# Altium schematic sheet mainboard.schdoc (part 2 of 2) (continued)
## Nets (continued)
INTR: D21.18(INTR) D40.17(INT)
IOCOM/: D4.13 D34.6 D42.9 D42.12
IOR/: D53.18(X1) X7.45(B14) X8.45(B14) X9.45(B14) X10.45(B14) X11.45(B14) X12.45(B14) X13.45(B14) X14.45(B14)
IORD/: D2.2 D30.13(IOR) D31.1 D34.13 D47.1(~{I/OR}) D51.15(B3) D53.2(A1) DR3.3
IOW/: D53.16(X2) X7.44(B13) X8.44(B13) X9.44(B13) X10.44(B13) X11.44(B13) X12.44(B13) X13.44(B13) X14.44(B13)
IOWR/: D2.4 D30.12(AIOW) D47.2(~{I/OW}) D51.17(B4) D53.4(A2) D61.10 D61.12 DR3.2
IREN/: D24.13(OE) D45.21(PB3)
IRQ: D50.11 D54.19(~{IRQ}) R34.1
IRQ0: D40.18(IR0) D49.10(OUT0)
IRQ1: D5.9(Q2) D37.12 D37.13 D40.19(IR1)
IRQ2: D40.20(IR2) S6.4 X7.35(B4) X8.35(B4) X9.35(B4) X10.35(B4) X11.35(B4) X12.35(B4) X13.35(B4) X14.35(B4)
IRQ3: D40.21(IR3) S6.6 X7.56(B25) X8.56(B25) X9.56(B25) X10.56(B25) X11.56(B25) X12.56(B25) X13.56(B25) X14.56(B25)
IRQ4: D40.22(IR4) S6.8 X7.55(B24) X8.55(B24) X9.55(B24) X10.55(B24) X11.55(B24) X12.55(B24) X13.55(B24) X14.55(B24)
IRQ5: D40.23(IR5) X7.54(B23) X8.54(B23) X9.54(B23) X10.54(B23) X11.54(B23) X12.54(B23) X13.54(B23) X14.54(B23)
IRQ6: D40.24(IR6) X7.53(B22) X8.53(B22) X9.53(B22) X10.53(B22) X11.53(B22) X12.53(B22) X13.53(B22) X14.53(B22)
IRQ7: D40.25(IR7) S6.2 X7.52(B21) X8.52(B21) X9.52(B21) X10.52(B21) X11.52(B21) X12.52(B21) X13.52(B21) X14.52(B21)
KBCLK: D36.2(D1) D37.8 R15.2 X3.1
KBDATA: D37.11 D38.11(SR) R12.2 X4.2
LAEN: D16.4 D16.5 D24.4(OE)
LAEN/: D16.6 D24.10(OE) D27.1(OC) D28.1(OC) D29.1(OC) D30.6(AEN) D42.10 D51.1(EX)
LALE: D19.5(Q1) D27.11(G) D28.11(G) D29.11(G)
LDAT0: D40.11(D0) D43.2(A1) D45.34(D0) D47.30(D0) D48.15(D1) D49.8(D0) D52.3(D0) D54.4(AD0) D68.15(D1) D77.18(B1)
LDAT1: D40.10(D1) D43.3(A2) D45.33(D1) D47.29(D1) D48.1(D2) D49.7(D1) D52.4(D1) D54.5(AD1) D68.1(D2) D77.17(B2)
LDAT2: D40.9(D2) D43.4(A3) D45.32(D2) D47.28(D2) D48.2(D3) D49.6(D2) D52.7(D2) D54.6(AD2) D68.2(D3) D77.16(B3)
LDAT3: D40.8(D3) D43.5(A4) D45.31(D3) D47.27(D3) D48.3(D4) D49.5(D3) D52.8(D3) D54.7(AD3) D68.3(D4) D77.15(B4)
LDAT4: D40.7(D4) D43.6(A5) D45.30(D4) D47.26(D4) D49.4(D4) D52.13(D4) D54.8(AD4) D69.15(D1) D77.14(B5)
LDAT5: D40.6(D5) D43.7(A6) D45.29(D5) D47.23(D5) D49.3(D5) D52.14(D5) D54.9(AD5) D69.1(D2) D77.13(B6)
LDAT6: D40.5(D6) D43.8(A7) D45.28(D6) D47.22(D6) D49.2(D6) D52.17(D6) D54.10(AD6) D69.2(D3) D77.12(B7)
LDAT7: D10.12(D2) D40.4(D7) D43.9(A8) D45.27(D7) D47.21(D7) D49.1(D7) D52.18(D7) D54.11(AD7) D69.3(D4) D77.11(B8)
LIOR/: D34.5 D40.3(~{RD}) D45.5(~{RD}) D49.22(~{RD}) D51.5(Y3)
LIOS/: D17.6 D43.19(G)
LIOW/: D4.1 D34.4 D40.2(~{WR}) D42.2 D45.36(~{WR}) D49.23(~{WR}) D51.3(Y4) D54.15(R/~{W})
LOCK/: D2.9 D21.29(LOCK)
LRAM/: D55.10(O3) D62.12 D63.1 R30.2
MAPS/: D4.12 D44.17(15) D61.13 D63.12
MAPW/: D61.11 D70.10(~{WE}) D71.10(~{WE})
MBDHS/: D58.19(G) D61.3
MBDLS/: D56.19(G) D64.3
MEM0: D56.2(A1) D59.11(O0) DS1.2(DI) DS1.14(DO) DS17.2(DI) DS17.14(DO) DS33.2(DI) DS33.14(DO) DS49.2(DI) DS49.14(DO)
MEM1: D56.3(A2) D59.12(O1) DS2.2(DI) DS2.14(DO) DS18.2(DI) DS18.14(DO) DS34.2(DI) DS34.14(DO) DS50.2(DI) DS50.14(DO)
MEM2: D56.4(A3) D59.13(O2) DS3.2(DI) DS3.14(DO) DS19.2(DI) DS19.14(DO) DS35.2(DI) DS35.14(DO) DS51.2(DI) DS51.14(DO)
MEM3: D56.5(A4) D59.15(O3) DS4.2(DI) DS4.14(DO) DS20.2(DI) DS20.14(DO) DS36.2(DI) DS36.14(DO) DS52.2(DI) DS52.14(DO)
MEM4: D56.6(A5) D59.16(O4) DS5.2(DI) DS5.14(DO) DS21.2(DI) DS21.14(DO) DS37.2(DI) DS37.14(DO) DS53.2(DI) DS53.14(DO)
MEM5: D56.7(A6) D59.17(O5) DS6.2(DI) DS6.14(DO) DS22.2(DI) DS22.14(DO) DS38.2(DI) DS38.14(DO) DS54.2(DI) DS54.14(DO)
MEM6: D56.8(A7) D59.18(O6) DS7.2(DI) DS7.14(DO) DS23.2(DI) DS23.14(DO) DS39.2(DI) DS39.14(DO) DS55.2(DI) DS55.14(DO)
MEM7: D56.9(A8) D59.19(O7) DS8.2(DI) DS8.14(DO) DS24.2(DI) DS24.14(DO) DS40.2(DI) DS40.14(DO) DS56.2(DI) DS56.14(DO)
MEM8: D58.2(A1) D60.11(O0) DS9.2(DI) DS9.14(DO) DS25.2(DI) DS25.14(DO) DS41.2(DI) DS41.14(DO) DS57.2(DI) DS57.14(DO)
MEM9: D58.3(A2) D60.12(O1) DS10.2(DI) DS10.14(DO) DS26.2(DI) DS26.14(DO) DS42.2(DI) DS42.14(DO) DS58.2(DI) DS58.14(DO)
MEM10: D58.4(A3) D60.13(O2) DS11.2(DI) DS11.14(DO) DS27.2(DI) DS27.14(DO) DS43.2(DI) DS43.14(DO) DS59.2(DI) DS59.14(DO)
MEM11: D58.5(A4) D60.15(O3) DS12.2(DI) DS12.14(DO) DS28.2(DI) DS28.14(DO) DS44.2(DI) DS44.14(DO) DS60.2(DI) DS60.14(DO)
MEM12: D58.6(A5) D60.16(O4) DS13.2(DI) DS13.14(DO) DS29.2(DI) DS29.14(DO) DS45.2(DI) DS45.14(DO) DS61.2(DI) DS61.14(DO)
MEM13: D58.7(A6) D60.17(O5) DS14.2(DI) DS14.14(DO) DS30.2(DI) DS30.14(DO) DS46.2(DI) DS46.14(DO) DS62.2(DI) DS62.14(DO)
MEM14: D58.8(A7) D60.18(O6) DS15.2(DI) DS15.14(DO) DS31.2(DI) DS31.14(DO) DS47.2(DI) DS47.14(DO) DS63.2(DI) DS63.14(DO)
MEM15: D58.9(A8) D60.19(O7) DS16.2(DI) DS16.14(DO) DS32.2(DI) DS32.14(DO) DS48.2(DI) DS48.14(DO) DS64.2(DI) DS64.14(DO)
MEM16/: D32.2(A5) D55.12(O1) D61.4 R29.1
MEMC/: D61.5 D63.6 D64.5 D65.3 D65.11 D65.12
MEMD/: D2.5 D62.11
MEMR/: D53.14(X3) X7.43(B12) X8.43(B12) X9.43(B12) X10.43(B12) X11.43(B12) X12.43(B12) X13.43(B12) X14.43(B12)
MEMW/: D53.12(X4) X7.42(B11) X8.42(B11) X9.42(B11) X10.42(B11) X11.42(B11) X12.42(B11) X13.42(B11) X14.42(B11)
MPS/: D4.11 D77.19(G)
MRD/: D30.7(MRD) D31.13 D34.12 D47.3(MEMR) D53.6(A3) D63.4 D64.12 DR3.5
MRDP/: D59.22(~{OE}) D60.22(~{OE}) D64.11
MWR/: D30.8(AMW) D47.4(MEMW) D53.8(A4) D63.5 D64.10 DR3.6
MXA: D66.5(Q2) D66.6(D3) D73.1(~{A}/B) D74.1(~{A}/B) D75.14(A)
NMIS/: D4.2 D44.11(10)
OSC: D31.8 D39.1(B) X7.61(B30) X8.61(B30) X9.61(B30) X10.61(B30) X11.61(B30) X12.61(B30) X13.61(B30) X14.61(B30)
OSC24: D6.3(C1) D6.11(C2) D19.3(C1) D66.9(CLK) S1.2
OUT2: D37.4 D45.12(PC5) D49.17(OUT2)
PA0: D38.16(H/QH) D45.4(PA0)
PA1: D38.4(G/QG) D45.3(PA1)
PA2: D38.15(F/QF) D45.2(PA2)
PA3: D38.5(E/QE) D45.1(PA3)
PA4: D38.14(D/QD) D45.40(PA4)
PA5: D38.6(C/QC) D45.39(PA5)
PA6: D38.13(B/QB) D45.38(PA6)
PA7: D38.7(A/QA) D45.37(PA7)
PADR0: D15.12 D45.9(A0) D49.19(A0) D50.3 D51.9(Y1)
PADR1: D45.8(A1) D49.20(A1) D51.7(Y2)
PCLK: D13.2(PCLK) D47.12(CLK)
PGOOD: C133.1 D3.12 D50.5 R35.1 X5.1
PICS/: D40.1(~{CS}) D44.3(2)
PITS/: D44.5(4) D49.21(~{CS})
PPIS/: D44.7(6) D45.6(~{CS})
PROM/: D55.11(O2) D64.13 R31.1
PULUP: D19.1(~{R1}) D19.4(~{S1}) D19.13(~{R2}) DR1.2
QS0: D21.25(QS0) D22.25(QS0)
QS1: D21.24(QS1) D22.24(QS1)
RA0: DR5.2 DS1.5(A0) DS2.5(A0) DS3.5(A0) DS4.5(A0) DS5.5(A0) DS6.5(A0) DS7.5(A0) DS8.5(A0) DS9.5(A0) DS10.5(A0) DS11.5(A0) DS12.5(A0) DS13.5(A0) DS14.5(A0) DS15.5(A0) DS16.5(A0) DS17.5(A0) DS18.5(A0) DS19.5(A0) DS20.5(A0) DS21.5(A0) DS22.5(A0) DS23.5(A0) DS24.5(A0) DS25.5(A0) DS26.5(A0) DS27.5(A0) DS28.5(A0) DS29.5(A0) DS30.5(A0) DS31.5(A0) DS32.5(A0) DS33.5(A0) DS34.5(A0) DS35.5(A0) DS36.5(A0) DS37.5(A0) DS38.5(A0) DS39.5(A0) DS40.5(A0) DS41.5(A0) DS42.5(A0) DS43.5(A0) DS44.5(A0) DS45.5(A0) DS46.5(A0) DS47.5(A0) DS48.5(A0) DS49.5(A0) DS50.5(A0) DS51.5(A0) DS52.5(A0) DS53.5(A0) DS54.5(A0) DS55.5(A0) DS56.5(A0) DS57.5(A0) DS58.5(A0) DS59.5(A0) DS60.5(A0) DS61.5(A0) DS62.5(A0) DS63.5(A0) DS64.5(A0)
RA1: DR5.6 DS1.7(A1) DS2.7(A1) DS3.7(A1) DS4.7(A1) DS5.7(A1) DS6.7(A1) DS7.7(A1) DS8.7(A1) DS9.7(A1) DS10.7(A1) DS11.7(A1) DS12.7(A1) DS13.7(A1) DS14.7(A1) DS15.7(A1) DS16.7(A1) DS17.7(A1) DS18.7(A1) DS19.7(A1) DS20.7(A1) DS21.7(A1) DS22.7(A1) DS23.7(A1) DS24.7(A1) DS25.7(A1) DS26.7(A1) DS27.7(A1) DS28.7(A1) DS29.7(A1) DS30.7(A1) DS31.7(A1) DS32.7(A1) DS33.7(A1) DS34.7(A1) DS35.7(A1) DS36.7(A1) DS37.7(A1) DS38.7(A1) DS39.7(A1) DS40.7(A1) DS41.7(A1) DS42.7(A1) DS43.7(A1) DS44.7(A1) DS45.7(A1) DS46.7(A1) DS47.7(A1) DS48.7(A1) DS49.7(A1) DS50.7(A1) DS51.7(A1) DS52.7(A1) DS53.7(A1) DS54.7(A1) DS55.7(A1) DS56.7(A1) DS57.7(A1) DS58.7(A1) DS59.7(A1) DS60.7(A1) DS61.7(A1) DS62.7(A1) DS63.7(A1) DS64.7(A1)
RA2: DR5.4 DS1.6(A2) DS2.6(A2) DS3.6(A2) DS4.6(A2) DS5.6(A2) DS6.6(A2) DS7.6(A2) DS8.6(A2) DS9.6(A2) DS10.6(A2) DS11.6(A2) DS12.6(A2) DS13.6(A2) DS14.6(A2) DS15.6(A2) DS16.6(A2) DS17.6(A2) DS18.6(A2) DS19.6(A2) DS20.6(A2) DS21.6(A2) DS22.6(A2) DS23.6(A2) DS24.6(A2) DS25.6(A2) DS26.6(A2) DS27.6(A2) DS28.6(A2) DS29.6(A2) DS30.6(A2) DS31.6(A2) DS32.6(A2) DS33.6(A2) DS34.6(A2) DS35.6(A2) DS36.6(A2) DS37.6(A2) DS38.6(A2) DS39.6(A2) DS40.6(A2) DS41.6(A2) DS42.6(A2) DS43.6(A2) DS44.6(A2) DS45.6(A2) DS46.6(A2) DS47.6(A2) DS48.6(A2) DS49.6(A2) DS50.6(A2) DS51.6(A2) DS52.6(A2) DS53.6(A2) DS54.6(A2) DS55.6(A2) DS56.6(A2) DS57.6(A2) DS58.6(A2) DS59.6(A2) DS60.6(A2) DS61.6(A2) DS62.6(A2) DS63.6(A2) DS64.6(A2)
RA3: DR5.3 DS1.12(A3) DS2.12(A3) DS3.12(A3) DS4.12(A3) DS5.12(A3) DS6.12(A3) DS7.12(A3) DS8.12(A3) DS9.12(A3) DS10.12(A3) DS11.12(A3) DS12.12(A3) DS13.12(A3) DS14.12(A3) DS15.12(A3) DS16.12(A3) DS17.12(A3) DS18.12(A3) DS19.12(A3) DS20.12(A3) DS21.12(A3) DS22.12(A3) DS23.12(A3) DS24.12(A3) DS25.12(A3) DS26.12(A3) DS27.12(A3) DS28.12(A3) DS29.12(A3) DS30.12(A3) DS31.12(A3) DS32.12(A3) DS33.12(A3) DS34.12(A3) DS35.12(A3) DS36.12(A3) DS37.12(A3) DS38.12(A3) DS39.12(A3) DS40.12(A3) DS41.12(A3) DS42.12(A3) DS43.12(A3) DS44.12(A3) DS45.12(A3) DS46.12(A3) DS47.12(A3) DS48.12(A3) DS49.12(A3) DS50.12(A3) DS51.12(A3) DS52.12(A3) DS53.12(A3) DS54.12(A3) DS55.12(A3) DS56.12(A3) DS57.12(A3) DS58.12(A3) DS59.12(A3) DS60.12(A3) DS61.12(A3) DS62.12(A3) DS63.12(A3) DS64.12(A3)
RA4: DR5.5 DS1.11(A4) DS2.11(A4) DS3.11(A4) DS4.11(A4) DS5.11(A4) DS6.11(A4) DS7.11(A4) DS8.11(A4) DS9.11(A4) DS10.11(A4) DS11.11(A4) DS12.11(A4) DS13.11(A4) DS14.11(A4) DS15.11(A4) DS16.11(A4) DS17.11(A4) DS18.11(A4) DS19.11(A4) DS20.11(A4) DS21.11(A4) DS22.11(A4) DS23.11(A4) DS24.11(A4) DS25.11(A4) DS26.11(A4) DS27.11(A4) DS28.11(A4) DS29.11(A4) DS30.11(A4) DS31.11(A4) DS32.11(A4) DS33.11(A4) DS34.11(A4) DS35.11(A4) DS36.11(A4) DS37.11(A4) DS38.11(A4) DS39.11(A4) DS40.11(A4) DS41.11(A4) DS42.11(A4) DS43.11(A4) DS44.11(A4) DS45.11(A4) DS46.11(A4) DS47.11(A4) DS48.11(A4) DS49.11(A4) DS50.11(A4) DS51.11(A4) DS52.11(A4) DS53.11(A4) DS54.11(A4) DS55.11(A4) DS56.11(A4) DS57.11(A4) DS58.11(A4) DS59.11(A4) DS60.11(A4) DS61.11(A4) DS62.11(A4) DS63.11(A4) DS64.11(A4)
RA5: DR5.7 DS1.10(A5) DS2.10(A5) DS3.10(A5) DS4.10(A5) DS5.10(A5) DS6.10(A5) DS7.10(A5) DS8.10(A5) DS9.10(A5) DS10.10(A5) DS11.10(A5) DS12.10(A5) DS13.10(A5) DS14.10(A5) DS15.10(A5) DS16.10(A5) DS17.10(A5) DS18.10(A5) DS19.10(A5) DS20.10(A5) DS21.10(A5) DS22.10(A5) DS23.10(A5) DS24.10(A5) DS25.10(A5) DS26.10(A5) DS27.10(A5) DS28.10(A5) DS29.10(A5) DS30.10(A5) DS31.10(A5) DS32.10(A5) DS33.10(A5) DS34.10(A5) DS35.10(A5) DS36.10(A5) DS37.10(A5) DS38.10(A5) DS39.10(A5) DS40.10(A5) DS41.10(A5) DS42.10(A5) DS43.10(A5) DS44.10(A5) DS45.10(A5) DS46.10(A5) DS47.10(A5) DS48.10(A5) DS49.10(A5) DS50.10(A5) DS51.10(A5) DS52.10(A5) DS53.10(A5) DS54.10(A5) DS55.10(A5) DS56.10(A5) DS57.10(A5) DS58.10(A5) DS59.10(A5) DS60.10(A5) DS61.10(A5) DS62.10(A5) DS63.10(A5) DS64.10(A5)
RA7: DR5.8 DS1.9(A7) DS2.9(A7) DS3.9(A7) DS4.9(A7) DS5.9(A7) DS6.9(A7) DS7.9(A7) DS8.9(A7) DS9.9(A7) DS10.9(A7) DS11.9(A7) DS12.9(A7) DS13.9(A7) DS14.9(A7) DS15.9(A7) DS16.9(A7) DS17.9(A7) DS18.9(A7) DS19.9(A7) DS20.9(A7) DS21.9(A7) DS22.9(A7) DS23.9(A7) DS24.9(A7) DS25.9(A7) DS26.9(A7) DS27.9(A7) DS28.9(A7) DS29.9(A7) DS30.9(A7) DS31.9(A7) DS32.9(A7) DS33.9(A7) DS34.9(A7) DS35.9(A7) DS36.9(A7) DS37.9(A7) DS38.9(A7) DS39.9(A7) DS40.9(A7) DS41.9(A7) DS42.9(A7) DS43.9(A7) DS44.9(A7) DS45.9(A7) DS46.9(A7) DS47.9(A7) DS48.9(A7) DS49.9(A7) DS50.9(A7) DS51.9(A7) DS52.9(A7) DS53.9(A7) DS54.9(A7) DS55.9(A7) DS56.9(A7) DS57.9(A7) DS58.9(A7) DS59.9(A7) DS60.9(A7) DS61.9(A7) DS62.9(A7) DS63.9(A7) DS64.9(A7)
RA8: DR5.1 DS1.1(A8) DS2.1(A8) DS3.1(A8) DS4.1(A8) DS5.1(A8) DS6.1(A8) DS7.1(A8) DS8.1(A8) DS9.1(A8) DS10.1(A8) DS11.1(A8) DS12.1(A8) DS13.1(A8) DS14.1(A8) DS15.1(A8) DS16.1(A8) DS17.1(A8) DS18.1(A8) DS19.1(A8) DS20.1(A8) DS21.1(A8) DS22.1(A8) DS23.1(A8) DS24.1(A8) DS25.1(A8) DS26.1(A8) DS27.1(A8) DS28.1(A8) DS29.1(A8) DS30.1(A8) DS31.1(A8) DS32.1(A8) DS33.1(A8) DS34.1(A8) DS35.1(A8) DS36.1(A8) DS37.1(A8) DS38.1(A8) DS39.1(A8) DS40.1(A8) DS41.1(A8) DS42.1(A8) DS43.1(A8) DS44.1(A8) DS45.1(A8) DS46.1(A8) DS47.1(A8) DS48.1(A8) DS49.1(A8) DS50.1(A8) DS51.1(A8) DS52.1(A8) DS53.1(A8) DS54.1(A8) DS55.1(A8) DS56.1(A8) DS57.1(A8) DS58.1(A8) DS59.1(A8) DS60.1(A8) DS61.1(A8) DS62.1(A8) DS63.1(A8) DS64.1(A8)
RA60: DR6.10 P1.1 P2.1 P3.1 P4.1
RA61: DR6.11 P1.3 P2.3 P3.3 P4.3
RAS: D62.1 D65.1 D66.3(D1) D72.2(A1) D72.4(A2) D72.6(A3) D72.8(A4)
RAS0/: DR4.4 DS1.4(~{RAS}) DS2.4(~{RAS}) DS3.4(~{RAS}) DS4.4(~{RAS}) DS5.4(~{RAS}) DS6.4(~{RAS}) DS7.4(~{RAS}) DS8.4(~{RAS}) DS9.4(~{RAS}) DS10.4(~{RAS}) DS11.4(~{RAS}) DS12.4(~{RAS}) DS13.4(~{RAS}) DS14.4(~{RAS}) DS15.4(~{RAS}) DS16.4(~{RAS})
RAS1/: DR4.5 DS17.4(~{RAS}) DS18.4(~{RAS}) DS19.4(~{RAS}) DS20.4(~{RAS}) DS21.4(~{RAS}) DS22.4(~{RAS}) DS23.4(~{RAS}) DS24.4(~{RAS}) DS25.4(~{RAS}) DS26.4(~{RAS}) DS27.4(~{RAS}) DS28.4(~{RAS}) DS29.4(~{RAS}) DS30.4(~{RAS}) DS31.4(~{RAS}) DS32.4(~{RAS})
RAS2/: DR4.6 DS33.4(~{RAS}) DS34.4(~{RAS}) DS35.4(~{RAS}) DS36.4(~{RAS}) DS37.4(~{RAS}) DS38.4(~{RAS}) DS39.4(~{RAS}) DS40.4(~{RAS}) DS41.4(~{RAS}) DS42.4(~{RAS}) DS43.4(~{RAS}) DS44.4(~{RAS}) DS45.4(~{RAS}) DS46.4(~{RAS}) DS47.4(~{RAS}) DS48.4(~{RAS})
RAS3/: DR4.7 DS49.4(~{RAS}) DS50.4(~{RAS}) DS51.4(~{RAS}) DS52.4(~{RAS}) DS53.4(~{RAS}) DS54.4(~{RAS}) DS55.4(~{RAS}) DS56.4(~{RAS}) DS57.4(~{RAS}) DS58.4(~{RAS}) DS59.4(~{RAS}) DS60.4(~{RAS}) DS61.4(~{RAS}) DS62.4(~{RAS}) DS63.4(~{RAS}) DS64.4(~{RAS})
REFR: D35.3(C1) D49.13(OUT1)
RES/: D9.1(CLR) D10.13(~{R2}) D16.8 D17.13 D20.1(CLR) D36.1(~{R1}) D36.13(~{R2}) D37.1 D37.2
RESET: C134.1 D13.10(RESET) D16.9 D21.21(RESET) D22.21(RESET) D45.35(RESET) D47.13(RESET)
RESET DRV: D37.3 R17.1 X7.33(B2) X8.33(B2) X9.33(B2) X10.33(B2) X11.33(B2) X12.33(B2) X13.33(B2) X14.33(B2)
RGEN/: D18.11 D33.1(OC)
RGLSTB: D14.6 D33.11(G)
RR14: D35.2(D1) D35.4(~{S1}) D35.10(~{S2}) D35.13(~{R2}) D36.4(~{S1}) D36.10(~{S2}) R14.2
RS0/: D29.15(Q5) D32.5(A0) DR2.7
RS1/: D29.16(Q6) D32.6(A1) DR2.6
RS2/: D29.19(Q7) D32.7(A2) D55.3(A4) DR2.10
RTCS/: D42.13 D44.8(7)
S0/: D2.12 D21.26(S0) D22.26(S0) D29.14(D5) D30.19(S0) DR3.7
S1/: D2.10 D21.27(S1) D22.27(S1) D29.17(D6) D30.3(S1) DR3.4
S2/: D21.28(S2) D22.28(S2) D29.18(D7) D30.18(S2) DR3.8
SEGS/: D42.1 D44.9(8)
SEGW/: D42.3 D48.12(GW)
SELH/: D26.19(G) D32.11(O2) DR2.4
SELL/: D25.1(EX) D25.19(EY) D32.12(O1) DR2.5
SEN: D37.5 D45.19(PB1)
SWEN/: D57.19(G) D64.6
T/C: D23.8 X7.58(B27) X8.58(B27) X9.58(B27) X10.58(B27) X11.58(B27) X12.58(B27) X13.58(B27) X14.58(B27)
TC/: D23.9 D47.36(TC) R25.1
TIMCLK: D36.3(C1) D36.11(C2) D39.12(QA) D49.9(CLK0) D49.15(CLK1) D49.18(CLK2)
TWOB/: D19.12(D2) D32.9(O4) DR2.2
WE0H/: DR4.8 DS9.3(~{WE}) DS10.3(~{WE}) DS11.3(~{WE}) DS12.3(~{WE}) DS13.3(~{WE}) DS14.3(~{WE}) DS15.3(~{WE}) DS16.3(~{WE}) DS25.3(~{WE}) DS26.3(~{WE}) DS27.3(~{WE}) DS28.3(~{WE}) DS29.3(~{WE}) DS30.3(~{WE}) DS31.3(~{WE}) DS32.3(~{WE})
WE0L/: DR4.3 DS1.3(~{WE}) DS2.3(~{WE}) DS3.3(~{WE}) DS4.3(~{WE}) DS5.3(~{WE}) DS6.3(~{WE}) DS7.3(~{WE}) DS8.3(~{WE}) DS17.3(~{WE}) DS18.3(~{WE}) DS19.3(~{WE}) DS20.3(~{WE}) DS21.3(~{WE}) DS22.3(~{WE}) DS23.3(~{WE}) DS24.3(~{WE})
WE1H/: DR4.1 DS41.3(~{WE}) DS42.3(~{WE}) DS43.3(~{WE}) DS44.3(~{WE}) DS45.3(~{WE}) DS46.3(~{WE}) DS47.3(~{WE}) DS48.3(~{WE}) DS57.3(~{WE}) DS58.3(~{WE}) DS59.3(~{WE}) DS60.3(~{WE}) DS61.3(~{WE}) DS62.3(~{WE}) DS63.3(~{WE}) DS64.3(~{WE})
WE1L/: DR4.2 DS33.3(~{WE}) DS34.3(~{WE}) DS35.3(~{WE}) DS36.3(~{WE}) DS37.3(~{WE}) DS38.3(~{WE}) DS39.3(~{WE}) DS40.3(~{WE}) DS49.3(~{WE}) DS50.3(~{WE}) DS51.3(~{WE}) DS52.3(~{WE}) DS53.3(~{WE}) DS54.3(~{WE}) DS55.3(~{WE}) DS56.3(~{WE})
WEH: D65.4 D72.15(A3) D72.17(A4)
WEL: D65.10 D72.11(A1) D72.13(A2)
NetBT1_1: BT1.1(+) VD2.A
NetC1_1: C1.1 Q1.2(OSC2) R3.2
NetC1_2: C1.2 D13.17(X1) R6.2
NetC2_1: C2.1 Q2.2(OSC2)
NetC2_2: C2.2 D31.6 R16.2 S7.1
NetC3_1: C3.1 D50.13 Q3.1(OSC1) R22.1
NetC4_1: C4.1 Q3.2(OSC2) R24.1
NetC5_1: C5.1 D50.14(VCC) D54.20(CKFS) D54.24(VCC) R26.1 R27.1 VD1.K VT1.C
NetC6_1: C6.1 D54.22(PS) R26.2
NetC7_1: C7.1 D54.18(~{R}) R27.2
NetD1_1: D1.1(~{R1}) D1.4(~{S1}) D10.1(~{R1}) D10.4(~{S1}) D10.10(~{S2}) R4.2
NetD1_5: D1.5(Q1) D3.5
NetD1_8: D1.8(~{Q2}) D3.9
NetD1_9: D1.9(Q2) D9.3(D1) D13.3(~{AEN1})
NetD1_10: D1.10(~{S2}) D3.3
NetD1_11: D1.11(C2) D2.6
NetD1_12: D1.12(D2) R2.2
NetD1_13: D1.13(~{R2}) D3.10 D35.9(Q2)
NetD2_8: D2.8 D7.5
NetD3_6: D3.6 D8.2(CLK)
NetD3_11: D3.11 D13.11(~{RES})
NetD4_3: D4.3 D10.11(C2)
NetD4_8: D4.8 D14.5
NetD4_9: D4.9 D34.11
NetD5_2: D5.2(D1) D9.15(Q6)
NetD5_4: D5.4(~{S1}) D5.6(~{Q1})
NetD5_8: D5.8(~{Q2}) D5.10(~{S2}) D38.1(S0)
NetD5_11: D5.11(C2) D36.9(Q2) D38.12(CLK)
NetD5_12: D5.12(D2) D38.17(QH')
NetD5_13: D5.13(~{R2}) D23.4 D38.9(CLR)
NetD6_1: D6.1(~{R1}) D6.4(~{S1}) D6.10(~{S2}) D6.13(~{R2}) R1.1
NetD6_5: D6.5(Q1) D6.12(D2)
NetD6_9: D6.9(Q2) D19.11(C2)
NetD7_6: D7.6 D9.14(D6)
NetD8_1: D8.1(CLR) D12.3(A4) D14.9 D19.8(~{Q2})
NetD8_3: D8.3(A) D8.4(B) D8.5(C) D8.6(D) D8.7(ENP) D8.9(LOAD) D8.10(ENT) DR1.3
NetD8_11: D8.11(QD) D12.4(A3)
NetD8_12: D8.12(QC) D12.7(A2)
NetD8_13: D8.13(QB) D12.6(A1)
NetD8_14: D8.14(QA) D12.5(A0)
NetD9_2: D9.2(Q1) D10.2(D1)
NetD9_5: D9.5(Q2) D9.6(D3) D14.1 D15.2 D16.3
NetD9_10: D9.10(Q4) D9.13(D5)
NetD9_12: D9.12(Q5) D15.3
NetD10_6: D10.6(~{Q1}) D35.12(D2)
NetD10_9: D10.9(Q2) D17.10
NetD11_2: D11.2 D18.13
NetD11_6: D11.6 D43.1(DIR)
NetD12_9: D12.9(O4) D20.13(D4) DR1.5
NetD12_10: D12.10(O3) D20.12(D3) DR1.6
NetD12_11: D12.11(O2) D20.5(D2) DR1.7
NetD12_12: D12.12(O1) D20.4(D1) DR1.8
NetD13_4: D13.4(RDY1) D15.1
NetD13_8: D13.8(CLK) S1.3
NetD13_12: D13.12(OSC) S1.1
NetD13_16: D13.16(X2) Q1.1(OSC1) R3.1 R5.1
NetD14_10: D14.10 D20.11(~{Q3})
NetD14_11: D14.11 D17.5
NetD14_13: D14.13 D15.4
NetD15_5: D15.5 D42.6 D44.18(G1)
NetD15_6: D15.6 D42.8 D44.19(G2)
NetD15_8: D15.8 D50.4
NetD15_9: D15.9 D15.11 D42.11
NetD15_10: D15.10 D54.17(DS)
NetD15_13: D15.13 D54.14(AS)
NetD17_8: D17.8 D21.17(NMI)
NetD17_9: D17.9 D22.32(INT)
NetD17_11: D17.11 D19.10(~{S2})
NetD17_12: D17.12 D20.6(~{Q2})
NetD18_1: D18.1 D20.15(Q4)
NetD21_23: D21.23(~{TEST}) D22.23(BUSY) R9.2
NetD21_30: D21.30(RQ/GT1) D22.31(RQ/GT0) R8.2
NetD21_31: D21.31(RQ/GT0) R7.2
NetD23_6: D23.6 D37.9 D37.10
NetD23_12: D23.12 D24.5(DI)
NetD24_11: D24.11(DO) S6.1 S6.3 S6.5 S6.7
NetD24_12: D24.12(DI) D50.10
NetD31_2: D31.2 D77.1(DIR)
NetD31_3: D31.3 D63.11 D68.11(GR) D69.11(GR)
NetD31_4: D31.4 D67.1(EX) D67.19(EY)
NetD31_5: D31.5 D31.10 R11.2 R16.1
NetD31_9: D31.9 S7.2
NetD31_11: D31.11 Q2.1(OSC1) R11.1
NetD32_10: D32.10(O3) D41.19(G) DR2.3
NetD36_5: D36.5(Q1) D36.12(D2)
NetD37_6: D37.6 R19.1
NetD38_18: D38.18(SL) R13.2
NetD39_8: D39.8(QD) D39.14(A)
NetD50_1: D50.1 D50.12 R22.2 R24.2
NetD50_2: D50.2 D54.2(OSC1)
NetD50_6: D50.6 D54.13(~{CE})
NetD61_1: D61.1 D61.6 D64.1
NetD61_8: D61.8 D68.12(GW) D69.12(GW)
NetD62_2: D62.2 D66.7(Q3) D66.11(D4)
NetD62_4: D62.4 D62.5 D66.2(Q1) D66.4(D2)
NetD62_6: D62.6 D64.9
NetD62_8: D62.8 D64.4
NetD62_13: D62.13 D65.13
NetD63_3: D63.3 D65.2
NetD64_8: D64.8 D65.6 D65.8
NetD66_1: D66.1(CLR) R32.1
NetD66_10: D66.10(Q4) D66.13(D5)
NetD66_12: D66.12(Q5) D66.14(D6)
NetD72_3: D72.3(Y4) DR4.16
NetD72_5: D72.5(Y3) DR4.9
NetD72_7: D72.7(Y2) DR4.15
NetD72_9: D72.9(Y1) DR4.14
NetD72_12: D72.12(Y4) DR4.10
NetD72_14: D72.14(Y3) DR4.11
NetD72_16: D72.16(Y2) DR4.12
NetD72_18: D72.18(Y1) DR4.13
NetD73_4: D73.4(1Y) DR5.15
NetD73_7: D73.7(2Y) DR5.11
NetD73_9: D73.9(3Y) DR5.13
NetD73_12: D73.12(4Y) DR5.14
NetD74_4: D74.4(1Y) DR5.12
NetD74_7: D74.7(2Y) DR5.10
NetD74_9: D74.9(3Y) DR5.9
NetD74_12: D74.12(4Y) DR5.16
NetD75_7: D75.7(1Y) DR6.7
NetD75_9: D75.9(2Y) DR6.6
NetD76_12: D76.12(Y3) DR6.16
NetD76_13: D76.13(Y2) DR6.15
NetD76_14: D76.14(Y1) DR6.14
NetD76_15: D76.15(Y0) DR6.13
NetDS1_13: DS1.13(A6) DS2.13(A6) DS3.13(A6) DS4.13(A6) DS5.13(A6) DS6.13(A6) DS7.13(A6) DS8.13(A6) DS9.13(A6) DS10.13(A6) DS11.13(A6) DS12.13(A6) DS13.13(A6) DS14.13(A6) DS15.13(A6) DS16.13(A6) P1.2
NetDS17_13: DS17.13(A6) DS18.13(A6) DS19.13(A6) DS20.13(A6) DS21.13(A6) DS22.13(A6) DS23.13(A6) DS24.13(A6) DS25.13(A6) DS26.13(A6) DS27.13(A6) DS28.13(A6) DS29.13(A6) DS30.13(A6) DS31.13(A6) DS32.13(A6) P2.2
NetDS33_13: DS33.13(A6) DS34.13(A6) DS35.13(A6) DS36.13(A6) DS37.13(A6) DS38.13(A6) DS39.13(A6) DS40.13(A6) DS41.13(A6) DS42.13(A6) DS43.13(A6) DS44.13(A6) DS45.13(A6) DS46.13(A6) DS47.13(A6) DS48.13(A6) P3.2
NetDS49_13: DS49.13(A6) DS50.13(A6) DS51.13(A6) DS52.13(A6) DS53.13(A6) DS54.13(A6) DS55.13(A6) DS56.13(A6) DS57.13(A6) DS58.13(A6) DS59.13(A6) DS60.13(A6) DS61.13(A6) DS62.13(A6) DS63.13(A6) DS64.13(A6) P4.2
NetR18_1: R18.1 VT2.C
NetR18_2: R18.2 VT1.B
NetR19_2: R19.2 X2.1
NetR20_1: R20.1 R21.1 VT2.B
NetR37_1: R37.1 X15.1
NetVD1_A: VD1.A VD2.K
NetX3_2: X3.2 X4.1

Not connected (* = marked no-connect by the designer): D1 6(~{Q1}); D6 6(~{Q1}) 8(~{Q2}); D8 15(RCO); D10 5(Q1) 8(~{Q2}); D13 14(EF1) 15(TANK); D19 6(~{Q1}) 9(Q2); D20 3(~{Q1}) 7(Q2) 10(Q3) 14(~{Q4}); D21 32(~{RD}); D30 9(MWT) 11(IOW) 17(MC/~{PD}); D35 6(~{Q1}) 8(~{Q2}); D36 6(~{Q1}) 8(~{Q2}); D38 8(QA'); D39 9(QC) 11(QB); D40 12(CAS0) 13(CAS1) 15(CAS2) 16(SP/~{EN}); D44 2(1) 4(3) 6(5) 10(9) 13(11) 14(12) 15(13); D45 10(PC7) 11(PC6) 13(PC4) 14(PC0) 15(PC1) 16(PC2) 17(PC3) 20(PB2) 22(PB4) 23(PB5); D47 5(MARK) 9(AEN); D51 4(A2) 6(A3) 14(X3) 16(X2); D66 15(Q6); D76 7(Y7) 9(Y6) 10(Y5) 11(Y4); DR1 4 9 10; DR2 8 9; DR3 10; DR6 5 8 9 12; X4 3; X7 39(B8); X8 39(B8); X9 39(B8); X10 39(B8); X11 39(B8); X12 39(B8); X13 39(B8); X14 39(B8)

## Buses and harness runs
bus BUS1_SCHEME1[0..0]

## Notes on the sheet
- Title
- Size:
- Date:
- File:
- A0
- Number:
- Time:
- Revision:
- Sheet
- of
- (in symbol 155LA13, part A) &
- (in symbol 155LA13, part B) &
- (in symbol 155LA13, part C) &
- (in symbol 155LA13, part D) &
- (in symbol CAP_10MKF) +
- (in symbol CAP_47MKF) +
- (in symbol KR512VI1) RTC
- (in symbol KR531TM2, part A) T
- (in symbol KR531TM2, part B) T
- (in symbol KR1533AP3, part A) BF
- (in symbol KR1533AP3, part B) BF
- (in symbol KR1533LA1, part A) &
- (in symbol KR1533LA1, part B) &
- (in symbol KR1533LA3, part A) &
- (in symbol KR1533LA3, part B) &
- (in symbol KR1533LA3, part C) &
- (in symbol KR1533LA3, part D) &
- (in symbol KR1533LI1, part A) &
- (in symbol KR1533LI1, part B) &
- (in symbol KR1533LI1, part C) &
- (in symbol KR1533LI1, part D) &
- (in symbol KR1533LP8, part B) LD
- (in symbol KR1533LP8, part C) LD
- (in symbol KR1533LP8, part D) LD
- (in symbol KR1533TM2, part A) T
- (in symbol KR1533TM2, part B) T
- (in symbol KR1810GF84) G

## Library data of the parts
C1 = CAP_16: value: 16pF
C3 C4 = CAP_22: value: 22pF
C6 C7 = CAP_6N8
D4 D18 D42 D61 D64 = KR1533LL1
D70 D71 = K132RU8
P1-P4 = Header 3: Header, 3-Pin; LatestRevisionDate: 17-Jul-2002; LatestRevisionNote: Re-released for DXP Platform.; Publisher: Altium Limited
S1 = Header 2X2: Header, 2-Pin, Dual row; LatestRevisionDate: 17-Jul-2002; LatestRevisionNote: Re-released for DXP Platform.; Publisher: Altium Limited
S7 X1-X3 X15 = Header 2: Header, 2-Pin; LatestRevisionDate: 17-Jul-2002; LatestRevisionNote: Re-released for DXP Platform.; Publisher: Altium Limited
X4 = ConnectorXTKeyboard
X5 = ConnectorPOWERP8P9